# EasyEDA Pro project CV键盘三键键盘四键键盘九键键盘有线小键盘.eprj, board 1x4+5_rgb_1
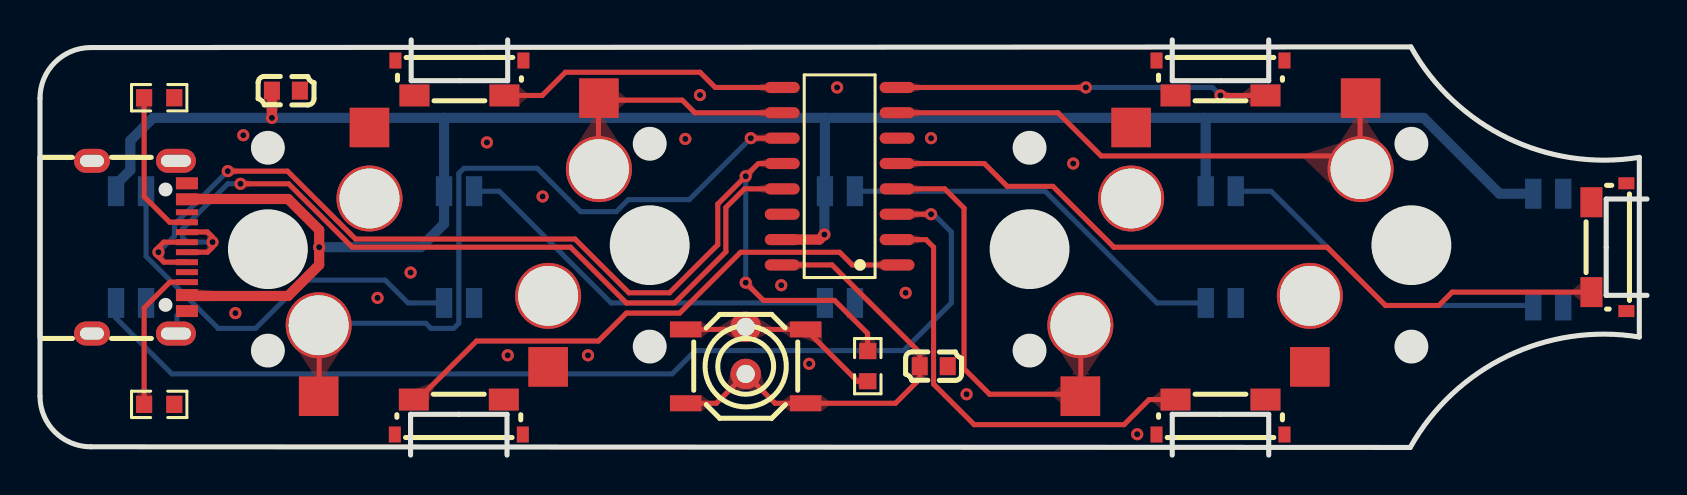
[diagram p9: board, top side]
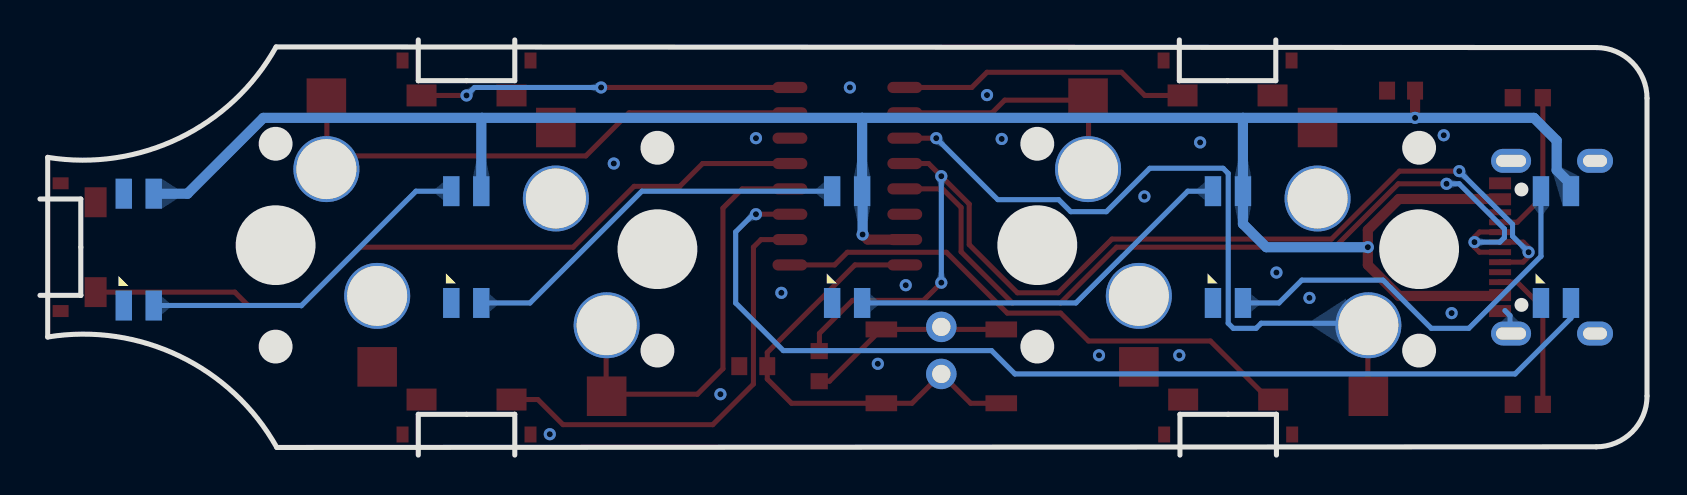
[diagram p10: board, bottom side, seen from below]

Outline 80.39 x 20.8 mm; copper layers: Top Layer, Bottom Layer. Coordinates in mm from the lower left corner of the outline.
Outline path: 0,17.87 0,2.95 arc(0.74,1.16) 2.54,0.41 68.54,0.38 arc(73.4,4.96) 80,5.91 80,14.91 arc(73.42,15.88) 68.57,20.45 2.54,20.41 arc(0.74,19.67) 0,17.87
Stack: Top Layer 0.035mm / Dielectric1 1.51mm FR4 er 4.5 / Bottom Layer 0.035mm

## Design rules (mm)
spacing Default (default): track to track 0.152, other pairs 0 to 0.152
track width Default (default): min 0.254, default 0.305, max 25.4
differential pair differentialPair (default): width min 0.127, default 0.254, max 2.54; gap min 0.152, default 0.152
via Default (default): diameter min 0.61, default 0.61, max 100.025; hole min 0.305, default 0.305, max 59.995
net GND uses gge1415

## Placement (name value [footprint] x y rotation side)
C1  100nF  [C0603]  44.71 4.45 0 top
C2  100nF  [C0603]  12.3 18.26 180 top
KEY1  -  [热插拔轴座]  68.57 10.41 90 bottom
KEY2  -  [热插拔轴座]  49.53 10.41 270 bottom
KEY3  -  [热插拔轴座]  30.47 10.41 90 bottom
KEY4  -  [热插拔轴座]  11.42 10.41 270 bottom
NOREF  -  [Pad_e101]  35.3 6.42 90 top
NOREF#2  -  [Pad_e99]  35.3 4.06 90 top
R1  5.1K  [R0603]  5.96 2.54 0 top
R2  5.1K  [R0603]  5.96 17.9 0 top
R3  10K  [R0603]  41.41 4.45 270 top
SW1  TS-1076S-A1B2  [SW-SMD_4P-L5.2-W5.2-P3.70-LS6.4]  35.3 4.45 180 top
SW2  TSA356G00-250  [SW-SMD_TSA356G00-250]  78.48 10.41 90 top
SW3  TSA356G00-250  [SW-SMD_TSA356G00-250]  59.05 18.89 180 top
SW4  TSA356G00-250  [SW-SMD_TSA356G00-250]  59.05 1.91 0 top
SW5  TSA356G00-250  [SW-SMD_TSA356G00-250]  20.98 18.89 180 top
SW6  TSA356G00-250  [SW-SMD_TSA356G00-250]  20.95 1.91 0 top
U1  CH552G  [sop-16_l10.0-w3.9-p1.27-ls6.0-bl]  40 13.97 90 top
U2  TypeC-16PIN  [USB-C-SMD_TYPE-C-6PIN-2MD-073]  4.97 10.41 270 top
U3  -  [ws2812反贴灯上装不挖槽反捏]  4.54 10.41 270 top
U4  -  [ws2812反贴灯上装不挖槽反捏]  20.95 10.41 270 top
U5  -  [ws2812反贴灯上装不挖槽反捏]  40 10.41 270 top
U6  -  [ws2812反贴灯上装不挖槽反捏]  59.05 10.41 270 top
U7  -  [ws2812反贴灯上装不挖槽反捏]  75.43 10.29 270 top

## Footprints (pads in the part's own frame, mm; a bottom-side part is the same pattern mirrored in y, then rotated)
C0603
  rect 0.8x0.9 smd: 1(-0.7,0) 2(0.7,0)
Pad_e99
  round 1.524 hole 0.914: 1(0,0)
Pad_e101
  round 1.524 hole 0.914: 2(0,0)
R0603
  rect 0.806x0.864 smd: 1(-0.753,0) 2(0.753,0)
sop-16_l10.0-w3.9-p1.27-ls6.0-bl
  oval 0.56x1.745 smd: 1(-4.445,-2.873) 2(-3.175,-2.873) 3(-1.905,-2.873) 4(-0.635,-2.873) 5(0.635,-2.873) 6(1.905,-2.873) 7(3.175,-2.873) 8(4.445,-2.873) 9(4.445,2.873) 10(3.175,2.873) 11(1.905,2.873) 12(0.635,2.873) 13(-0.635,2.873) 14(-1.905,2.873) 15(-3.175,2.873) 16(-4.445,2.873)
SW-SMD_4P-L5.2-W5.2-P3.70-LS6.4
  rect 1.58x0.8 smd: 1(-2.999,1.849) 2(2.999,1.849) 3(-2.999,-1.849) 4(2.999,-1.849)
SW-SMD_TSA356G00-250
  rect 1.501x1.1 smd: 1(-2.251,0.876) 2(2.251,0.876)
  rect 0.6x0.8 smd: 3(-3.2,-0.874) 4(3.2,-0.874)
USB-C-SMD_TYPE-C-6PIN-2MD-073
  rect 0.6x1.1 smd: 1(-3.2,2.375) 2(-2.4,2.375) 11(2.4,2.375) 12(3.2,2.375)
  rect 0.3x1.1 smd: 3(-1.75,2.375) 4(-1.25,2.375) 5(-0.75,2.375) 6(-0.25,2.375) 7(0.25,2.375) 8(0.75,2.375) 9(1.25,2.375) 10(1.75,2.375)
  oval 1.2x2 hole 0.6x1.5: 13(-4.325,1.825) 14(4.325,1.825)
  oval 1.2x1.8 hole 0.6x1.2: 13(-4.325,-2.375) 14(4.325,-2.375)
ws2812反贴灯上装不挖槽反捏
  rect 1.5x0.82 smd far side: 1(2.794,0.762) 2(2.794,-0.738) 3(-2.806,-0.738) 4(-2.806,0.762)
热插拔轴座
  rect 1.981x1.981 smd far side: 1(-5.995,-5.056) 2(7.466,-2.515)
  round 3.304 hole 3: 1(-2.439,-5.056) 2(3.91,-2.515)

## Nets
As in the schematic, except:
3.3V: C1.1 NOREF#2.1 SW1.1 SW1.2 U1.16
RST: NOREF.2 R3.2 SW1.3 SW1.4

Pads without a net: U1 6; U2 3 9; U7 4

## Via types
v1: diameter 0.61, hole 0.305, Top Layer to Bottom Layer, 31 vias

## Routing (per net, layer and track width the routed paths; a pad name or vN(x,y) marks a point on that pad's centre or on a via; arc(x,y) is an arc through that point)
3.3V: length 23.4
  Top Layer w0.254: 37.13,9.53 39.62,9.53 44.01,5.14 C1.1 44.01,3.81 42.79,2.6 SW1.1 36.77,2.6 NOREF#2.1 33.83,2.6 SW1.2
GND: length 1.3
  Bottom Layer w0.254: U2.14 6.85,6.14 6.85,6.98 7.11,7.24
  vias: v1(9.77,7.11) v1(10.17,16.02) v1(16.89,7.87) v1(18.54,9.14) v1(22.35,15.66) v1(23.4,5) v1(25.14,12.95) v1(27.41,5) v1(32.28,15.84) v1(33.01,18.03) v1(37.08,8.51) v1(38.48,4.57) v1(39.87,18.42) v1(43.3,8.13) v1(44.57,15.88) v1(46.35,3.05) v1(51.68,14.61) v1(54.88,1.05)
VCC: length 116.5
  Top Layer w0.508: U2.11 7.39,7.97 12.41,7.97 13.97,9.53 v1(13.97,10.41) 13.97,11.28 12.42,12.83 7.36,12.83 U2.2 ; U1.15 38.98,10.8 v1(39.24,11.05) ; C2.2 v1(11.6,16.89)
  Bottom Layer w0.508: 20.22,16.89 v1(11.6,16.89) 5.66,16.89 4.52,15.76 4.52,14.28 3.81,13.56 U3.3 ; 20.22,16.89 39.26,16.89 ; 20.22,16.89 20.21,16.88 U4.3 20.21,11.58 19.04,10.41 v1(13.97,10.41) ; 58.27,16.89 39.26,16.89 ; 58.27,16.89 69.21,16.89 73.01,13.09 U7.3 ; 58.27,16.89 58.31,16.85 U6.3 ; 39.26,16.89 39.26,16.89 U5.3 39.24,13.2 v1(39.24,11.05)
DM: length 42.4
  Top Layer w0.254: U1.13 35.24,13.34 34.31,12.4 34.31,10.19 31.75,7.62 29.33,7.62 26.54,10.41 15.62,10.41 12.44,13.59 v1(10.03,13.59) ; U2.7 8.38,10.16 8.63,10.41 8.63,10.92 8.38,11.18 7.36,11.18 U2.5
  Bottom Layer w0.254: v1(8.63,10.67) 7.36,10.67 7.13,10.9 7.13,11.33 9.39,13.59 v1(10.03,13.59)
DP: length 56.5
  Top Layer w0.254: U1.12 35.94,14.61 v1(35.3,13.97) 33.9,12.57 33.9,10.54 31.49,8.13 29.46,8.13 26.77,10.82 15.78,10.82 12.38,14.22 v1(9.39,14.22) ; U2.6 7.35,10.67 6.19,10.67 5.92,10.4 5.92,9.94 6.2,9.66 U2.8 ; v1(35.3,8.64) 36.19,7.75 39.75,7.75 41.4,6.1 41.4,5.21
  Bottom Layer w0.254: v1(35.3,8.64) v1(35.3,13.97) ; v1(9.39,14.22) 6.73,11.56 6.73,10.97 v1(5.92,10.16)
K1: length 28
  Top Layer w0.254: U1.7 50.92,17.14 53.08,14.99 65.27,14.99 66.03,14.22 66.03,17.78 65.95,17.78
K2: length 21.7
  Top Layer w0.254: 52.06,6.6 52.06,3.05 47.5,3.05 46.22,4.33 46.22,12.37 45.26,13.34 U1.4
K3: length 13
  Top Layer w0.254: 27.94,14.22 27.94,17.78 32.13,17.78 32.76,17.14 U1.10
K4: length 37
  Top Layer w0.254: 13.97,6.6 13.97,3.05 ; v1(35.56,15.88) U1.11
  Bottom Layer w0.254: 13.97,6.6 19.3,6.6 19.55,6.35 20.7,6.35 20.95,6.6 20.95,14.11 21.2,14.37 24.87,14.37 27.05,12.19 28.82,12.19 29.43,12.8 32.48,12.8 v1(35.56,15.88)
RGB: length 51.7
  Top Layer w0.254: U1.3 v1(44.57,12.06)
  Bottom Layer w0.254: U3.2 3.81,6.86 6.6,4.06 31.62,4.06 32.79,5.23 43.2,5.23 45.59,7.62 45.59,11.18 44.7,12.06
RST: length 10.2
  Top Layer w0.254: SW1.4 SW1.3 40.89,3.7 R3.2
S2: length 38
  Top Layer w0.254: U1.5 47.24,14.61 48.38,13.46 50.67,13.46 53.72,10.41 64.38,10.41 67.31,7.49 69.97,7.49 70.64,8.16 SW2.1
S3: length 18.6
  Top Layer w0.254: v1(59.05,18.02) 61.3,18.02 ; U1.8 v1(52.32,18.42)
  Bottom Layer w0.254: v1(59.05,18.02) 58.65,18.42 v1(52.32,18.42)
S4: length 22.3
  Top Layer w0.254: SW4.1 55.48,2.78 54.22,1.52 46.73,1.52 44.7,3.56 44.7,10.41 44.32,10.8 U1.2
S5: length 14.7
  Top Layer w0.254: 23.23,18.02 25.12,18.02 26.28,19.18 33.01,19.18 33.78,18.42 U1.9
S6: length 27.5
  Top Layer w0.254: SW6.1 18.91,2.78 21.84,5.72 27.94,5.72 29.33,7.11 32,7.11 35.05,10.16 40,10.16 40.63,9.53 42.87,9.53
$1N7262: length 21.1
  Bottom Layer w0.254: U3.4 5.31,9.96 8.91,6.35 10.79,6.35 13.2,8.76 17.27,8.76 18.41,7.62 U4.2
$1N7266: length 19.9
  Bottom Layer w0.254: U4.4 22.97,13.22 28.57,7.62 U5.2
$1N7270: length 19.9
  Bottom Layer w0.254: U6.2 55.88,7.62 50.28,13.22 U5.4
$1N9285: length 17.3
  Bottom Layer w0.254: U7.2 67.33,7.49 67.32,7.48 61.58,13.22 U6.4
$1N13052: length 7.5
  Top Layer w0.254: U2.10 6.5,8.66 5.21,7.37 R1.1
$1N13055: length 7.6
  Top Layer w0.254: R2.1 5.21,12.95 6.49,11.66 U2.4

## Copper pours and planes (outline as drawn; the poured copper is in the pictures)
GND on Top Layer: -4.36,24.11 81.11,24.11 81.11,-1.79 -4.36,-1.79
GND on Bottom Layer: -3.39,22.31 84.62,22.31 84.62,-2.58 -3.39,-2.58

Small or netless copper shapes (teardrops, artwork), in the pictures only: 67 on Top Layer, 28 on Bottom Layer

## Text on the board
Top Layer: 看着碍事拖动一下红色和蓝色框框铺铜就没了 / shift+b重新铺铜
